# EasyEDA Pro project PRO_project.eprj, schematic Schematic1_1

## Sheets
1 mcu: Create Date: 2024-07-25; Page Name: mcu; Project Name: PRO_project; Schematic Name: Schematic1; Update Date: 2024-08-04; Company: 嘉立创EDA; Page Size: A4; Version: V1.0
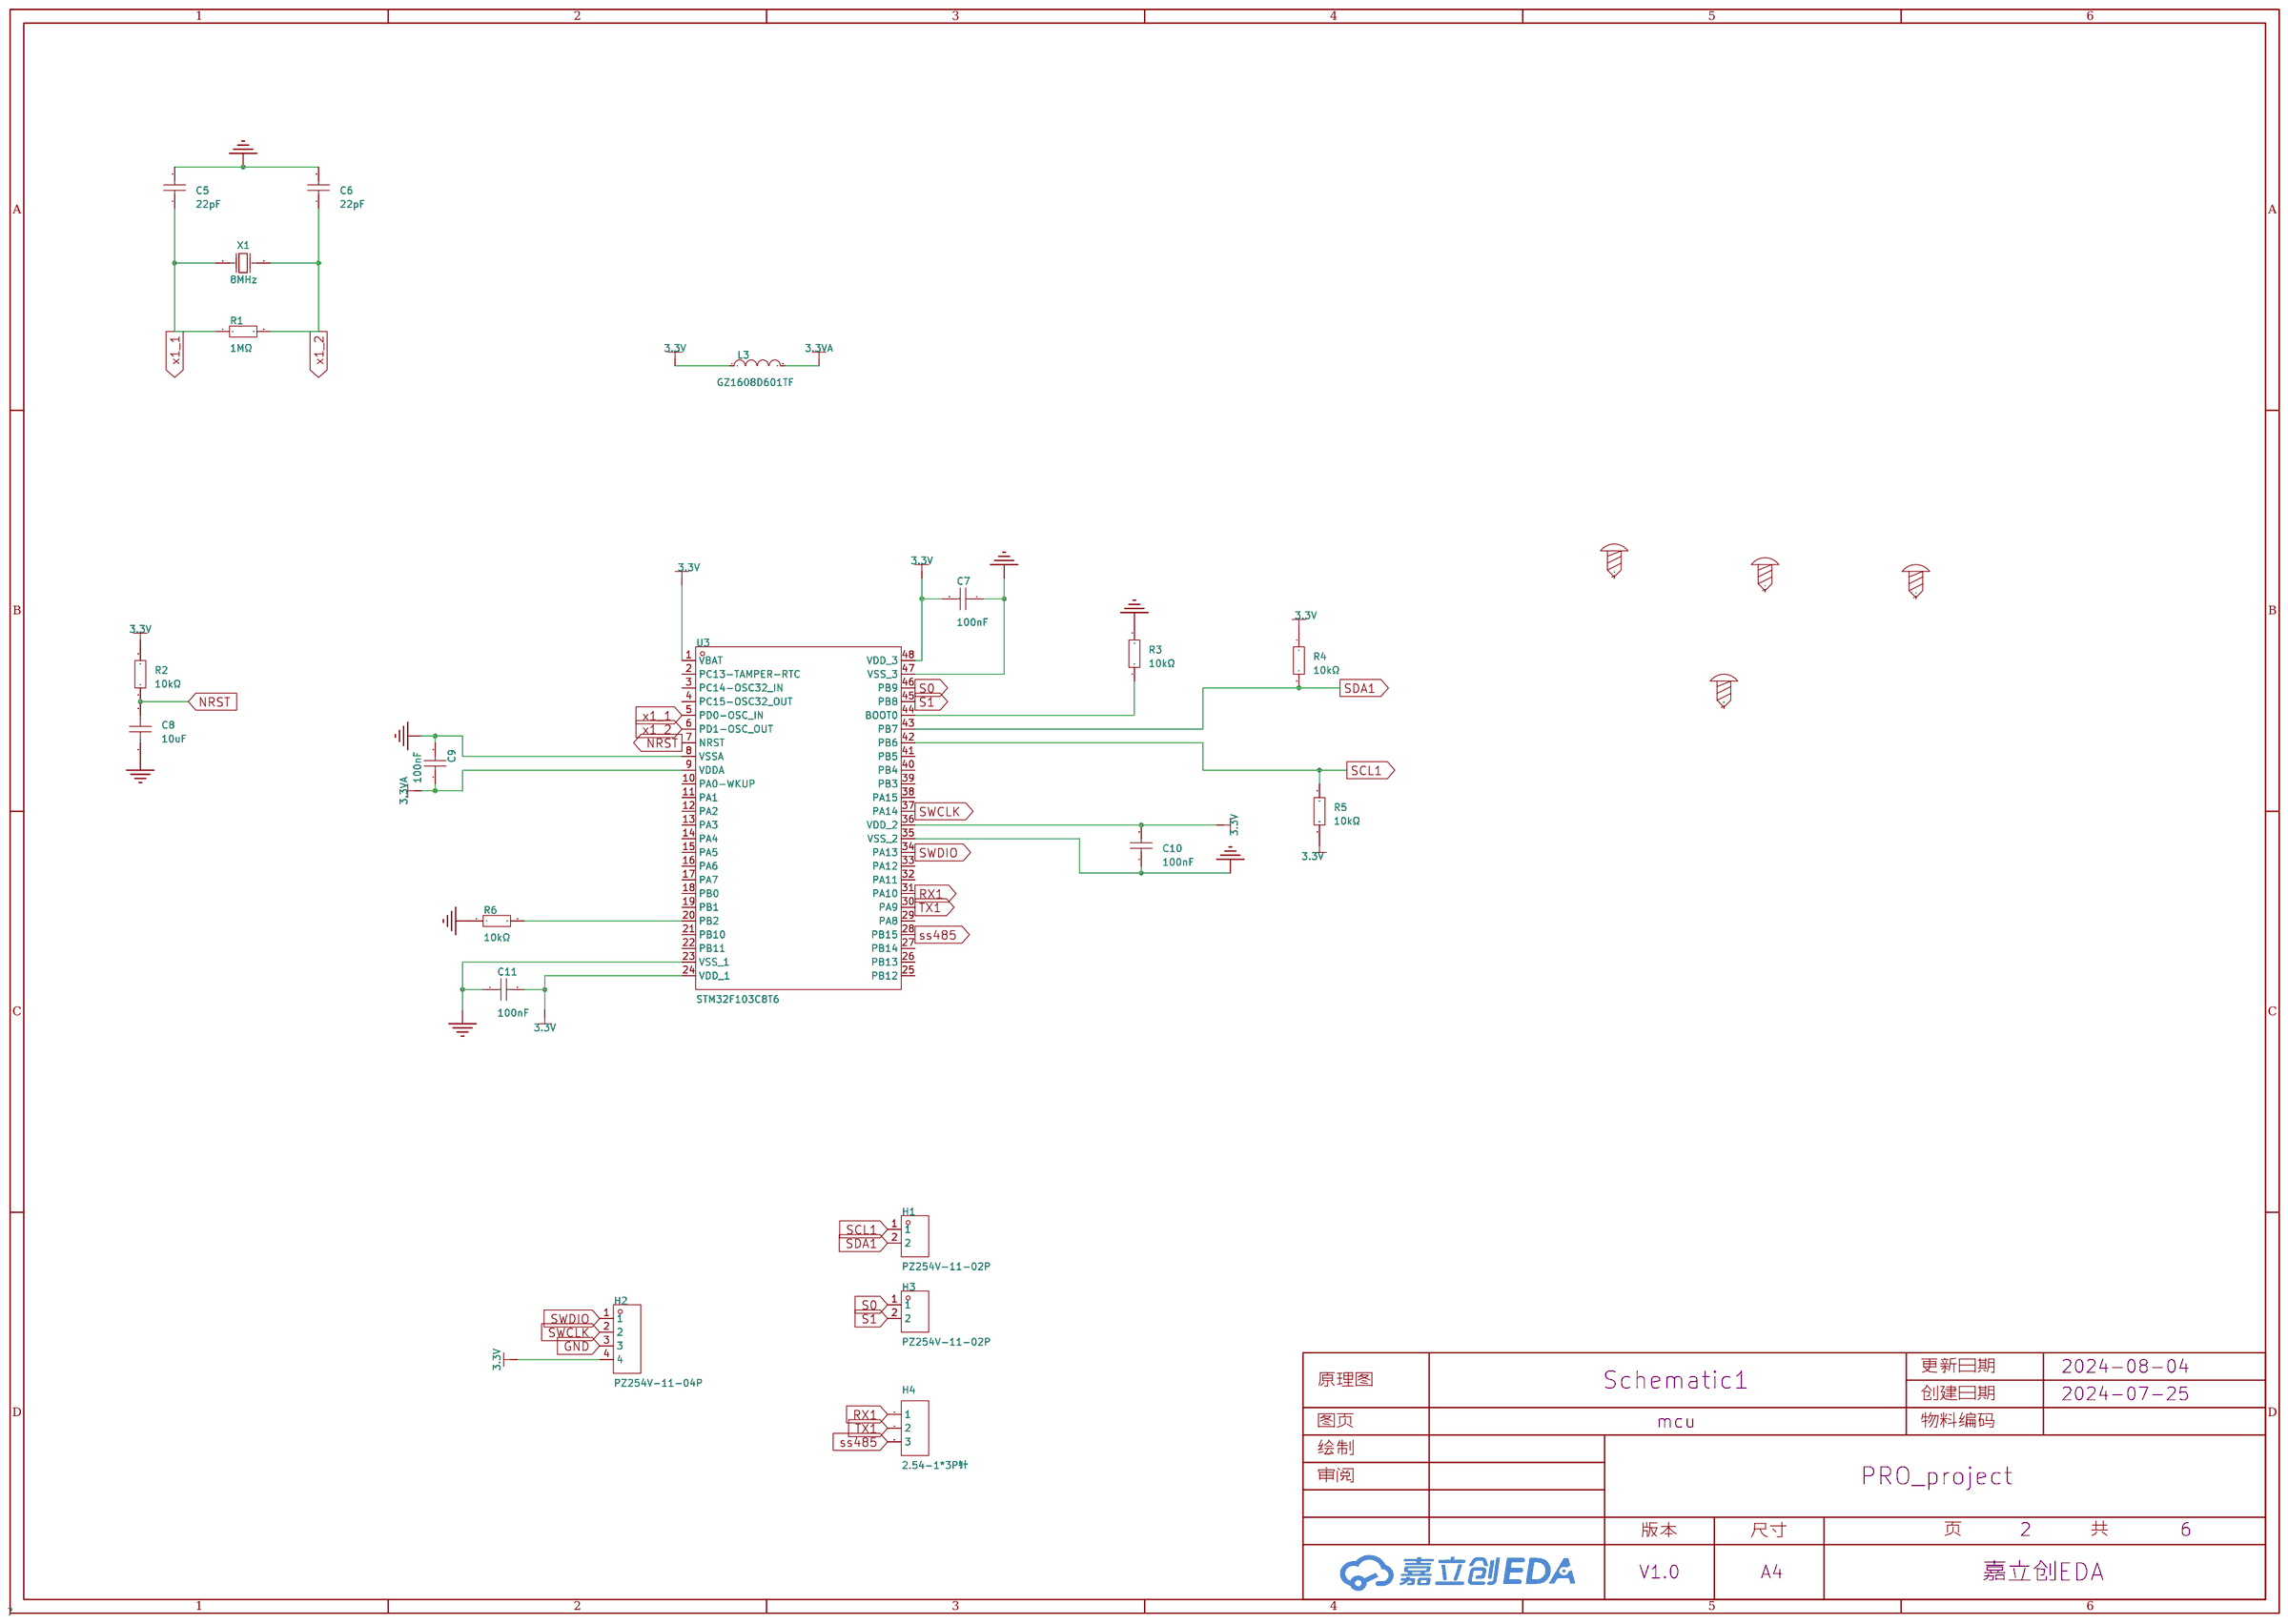
[diagram p7: mcu]
2 power: Page Name: power; Update Date: 2024-07-26
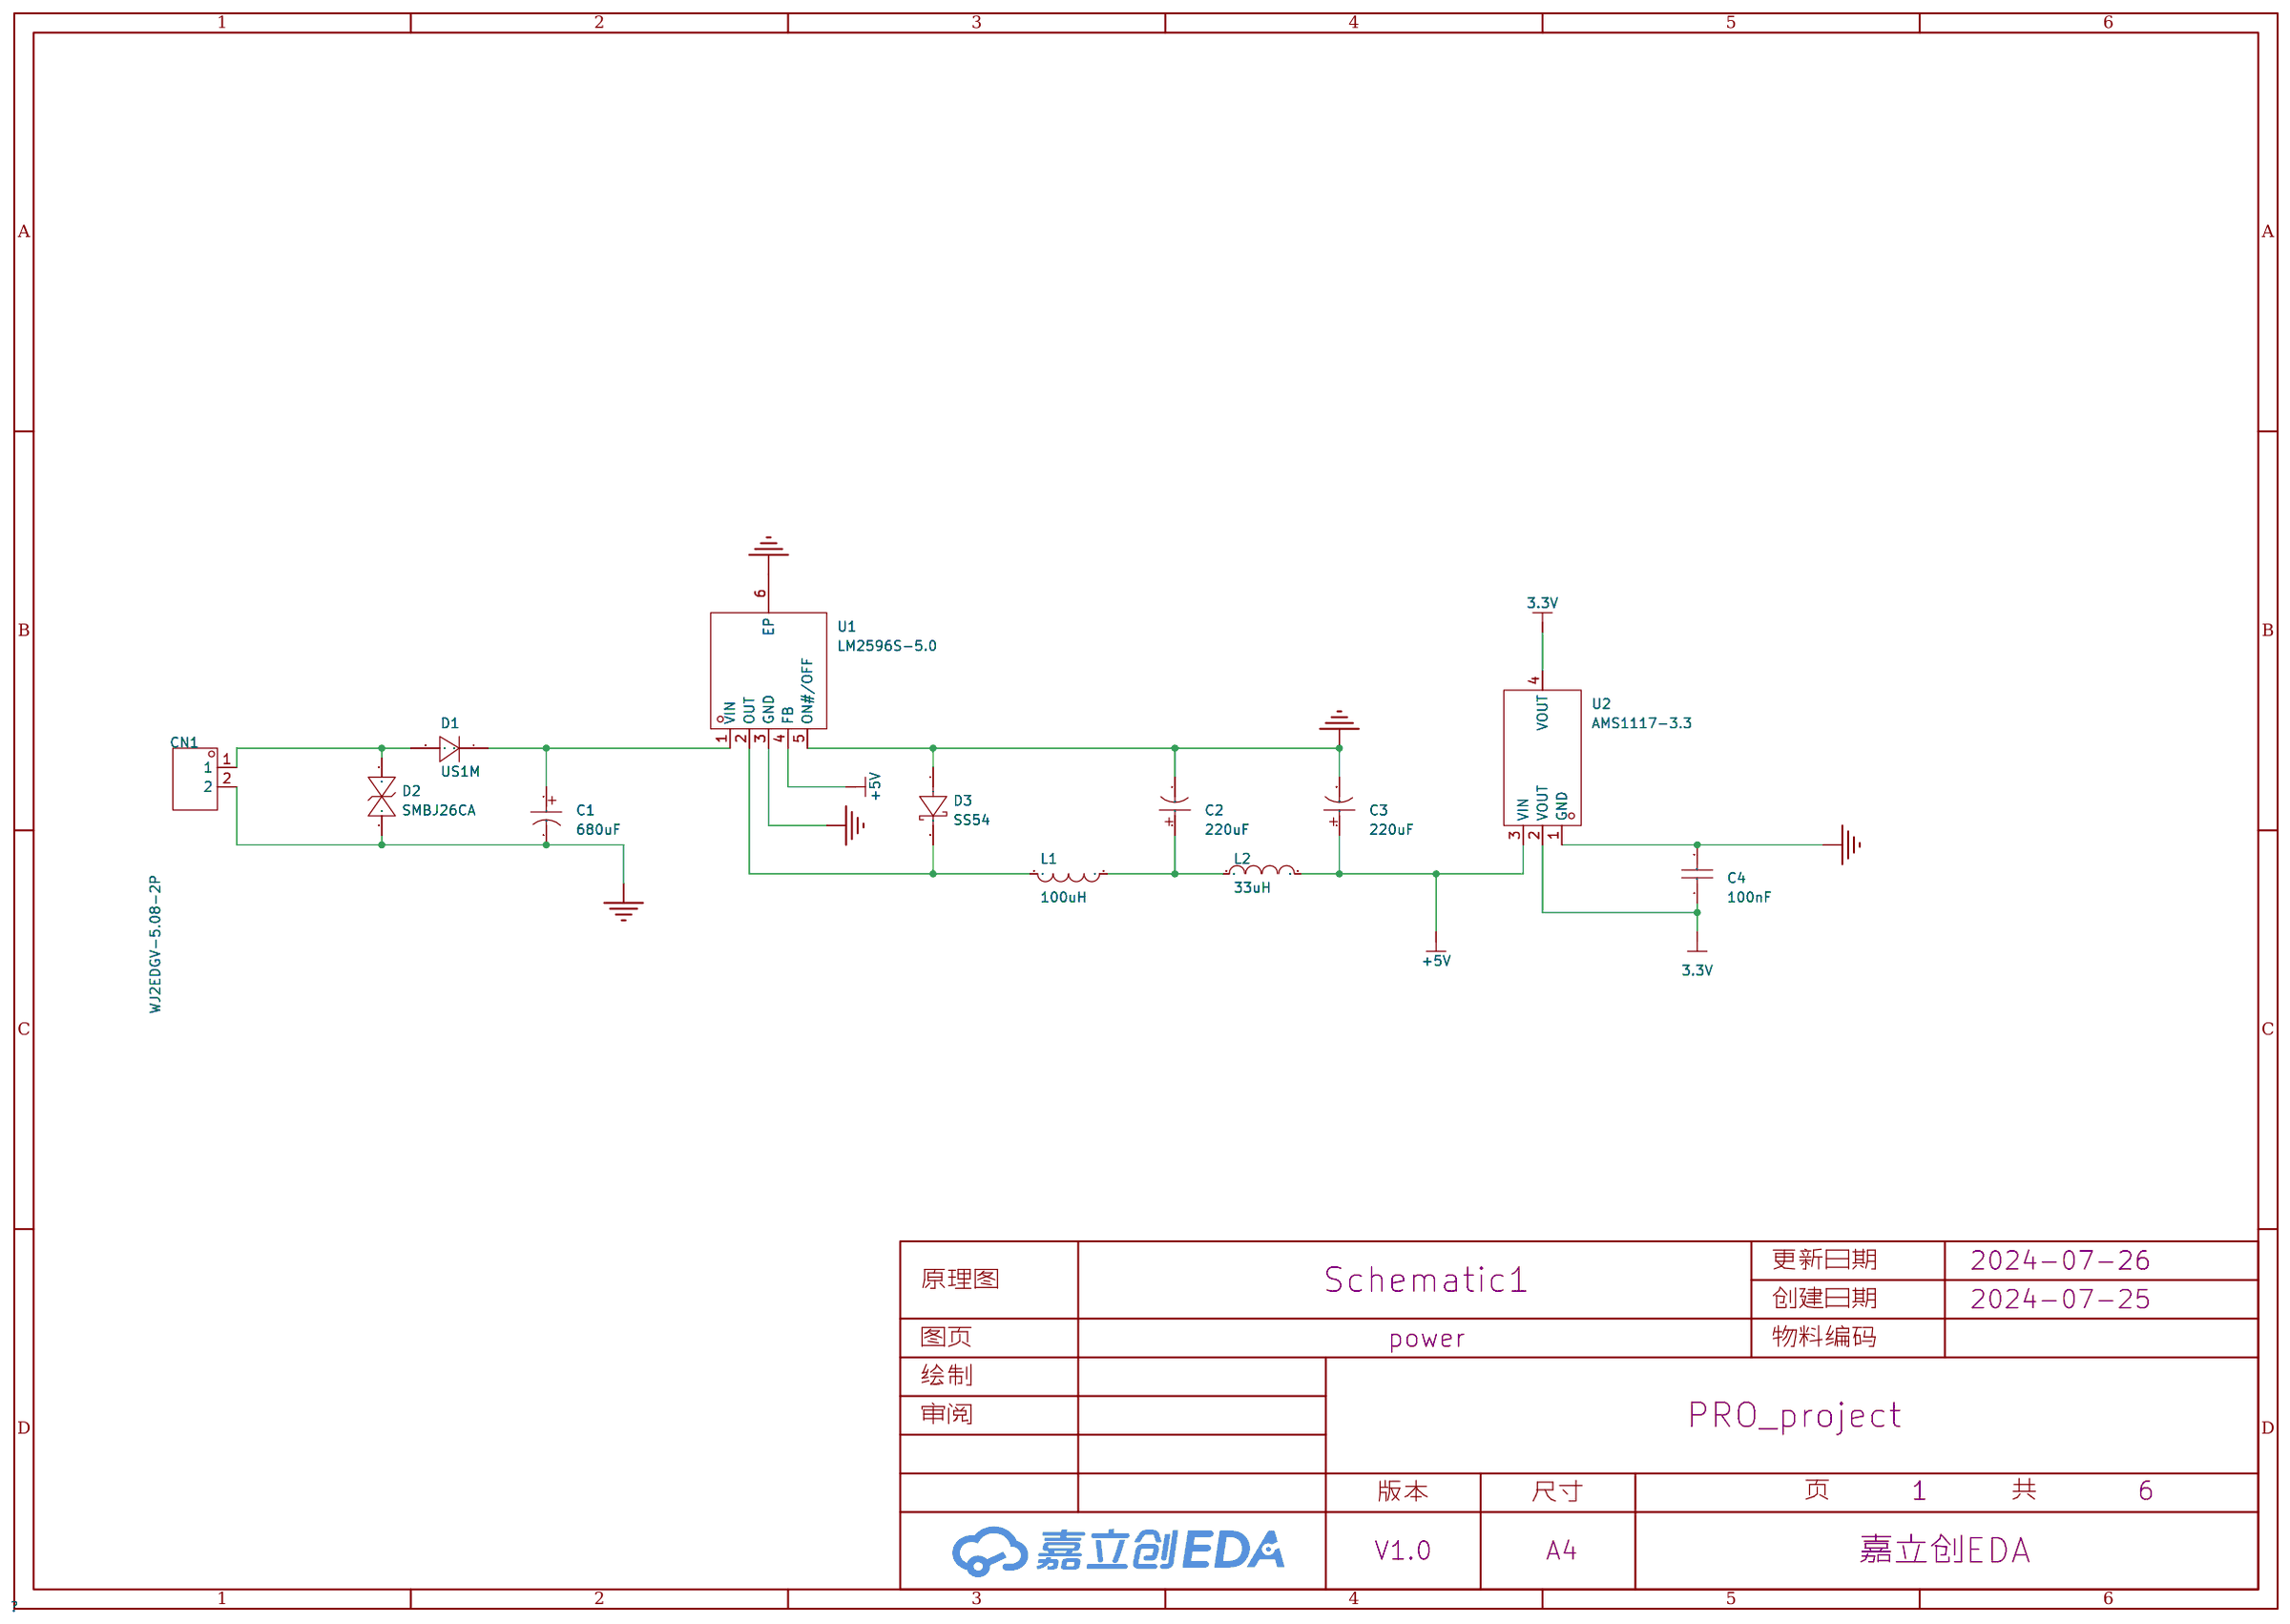
[diagram p8: power]
3 74H: Page Name: 74H; Update Date: 2024-07-31
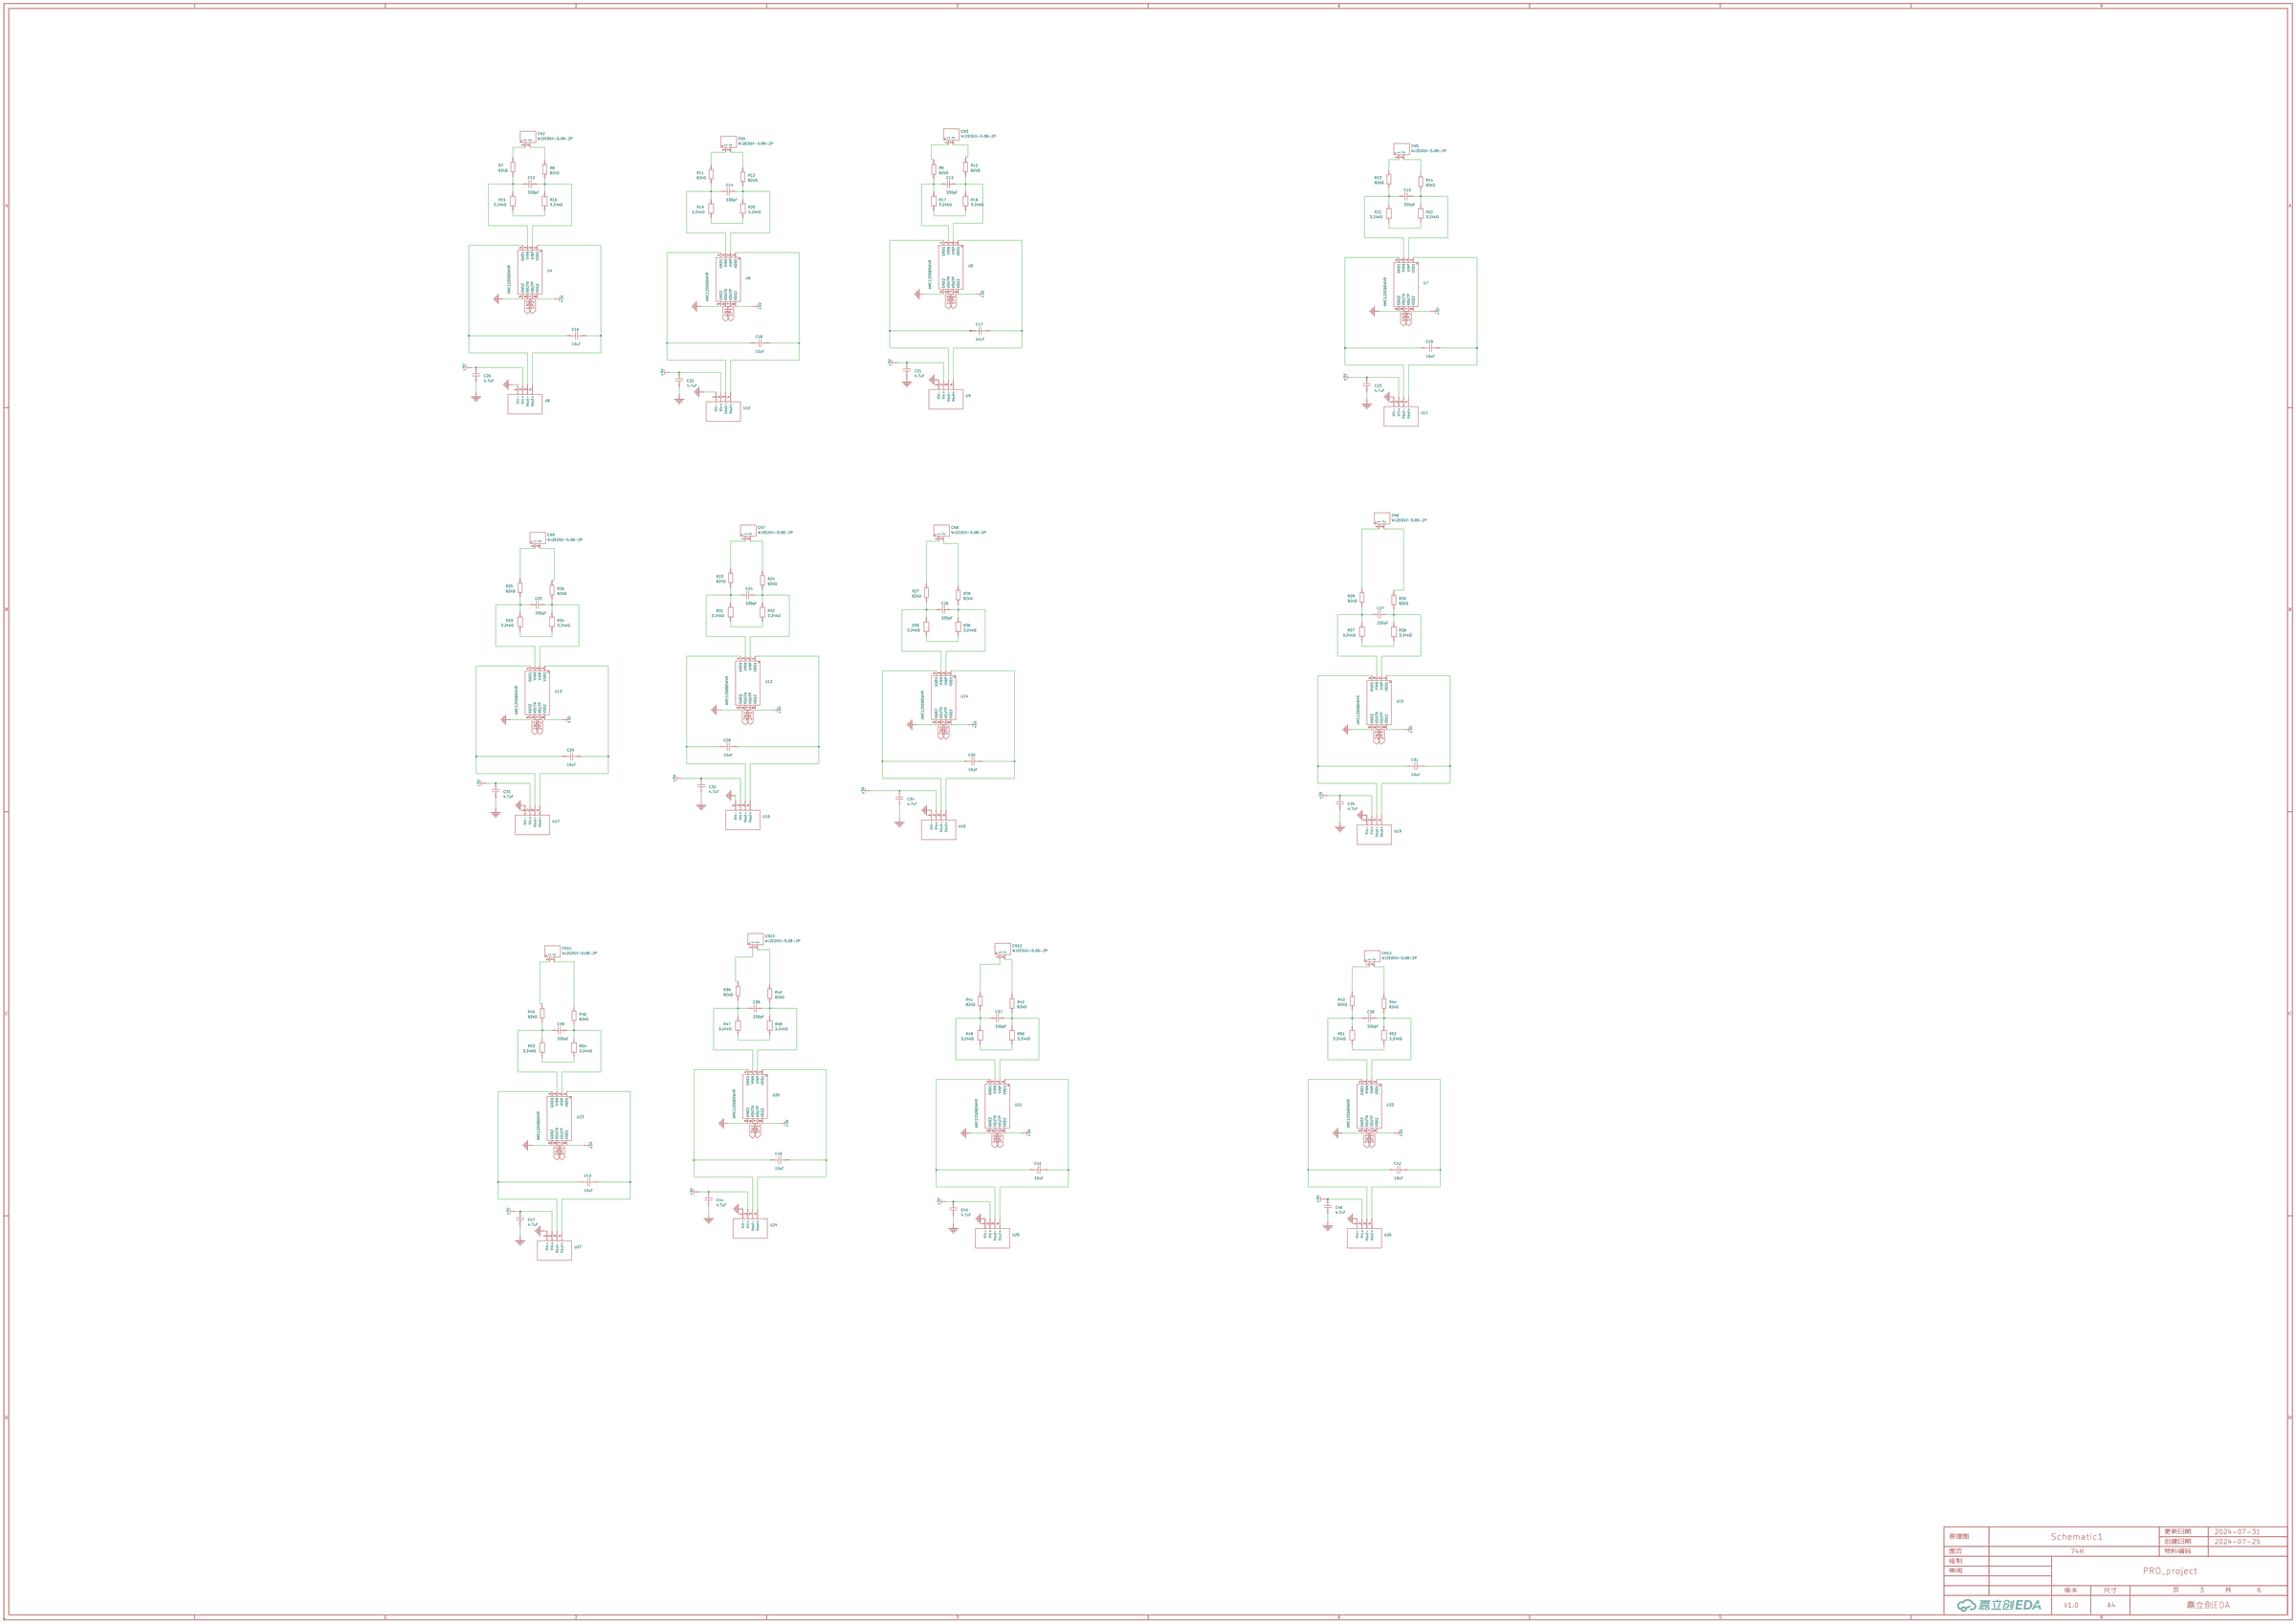
[diagram p9: 74H]
4 rs485: Create Date: 2024-08-06; Page Name: rs485; Schematic Name: Schematic1_1; Update Date: 2024-08-06